# EasyEDA Pro project 无线发射端.eprj

# Schematic Sheet1
Board Name: Board1; Create Date: 2025-03-26; Page Name: Sheet1; Project Name: 无线发射端; Schematic Name: Sheet1; Update Date: 2025-05-02; Address1: *; Address2: *; Address3: *; Address4: *; Application_BuildNumber: *; ApprovedBy: *; Author: *; CheckedBy: *; CompanyName: *; CurrentDate: *; CurrentTime: *; Date: *; DocumentFullPathAndName: *; DocumentName: *; DocumentNumber: *; DrawnBy: *; Engineer: *; ImagePath: *; ModifiedDate: *; Organization: *; ProjectName: *; Revision: *; Rule: *; SheetNumber: 1; SheetTotal: 1; Time: *; Title: *
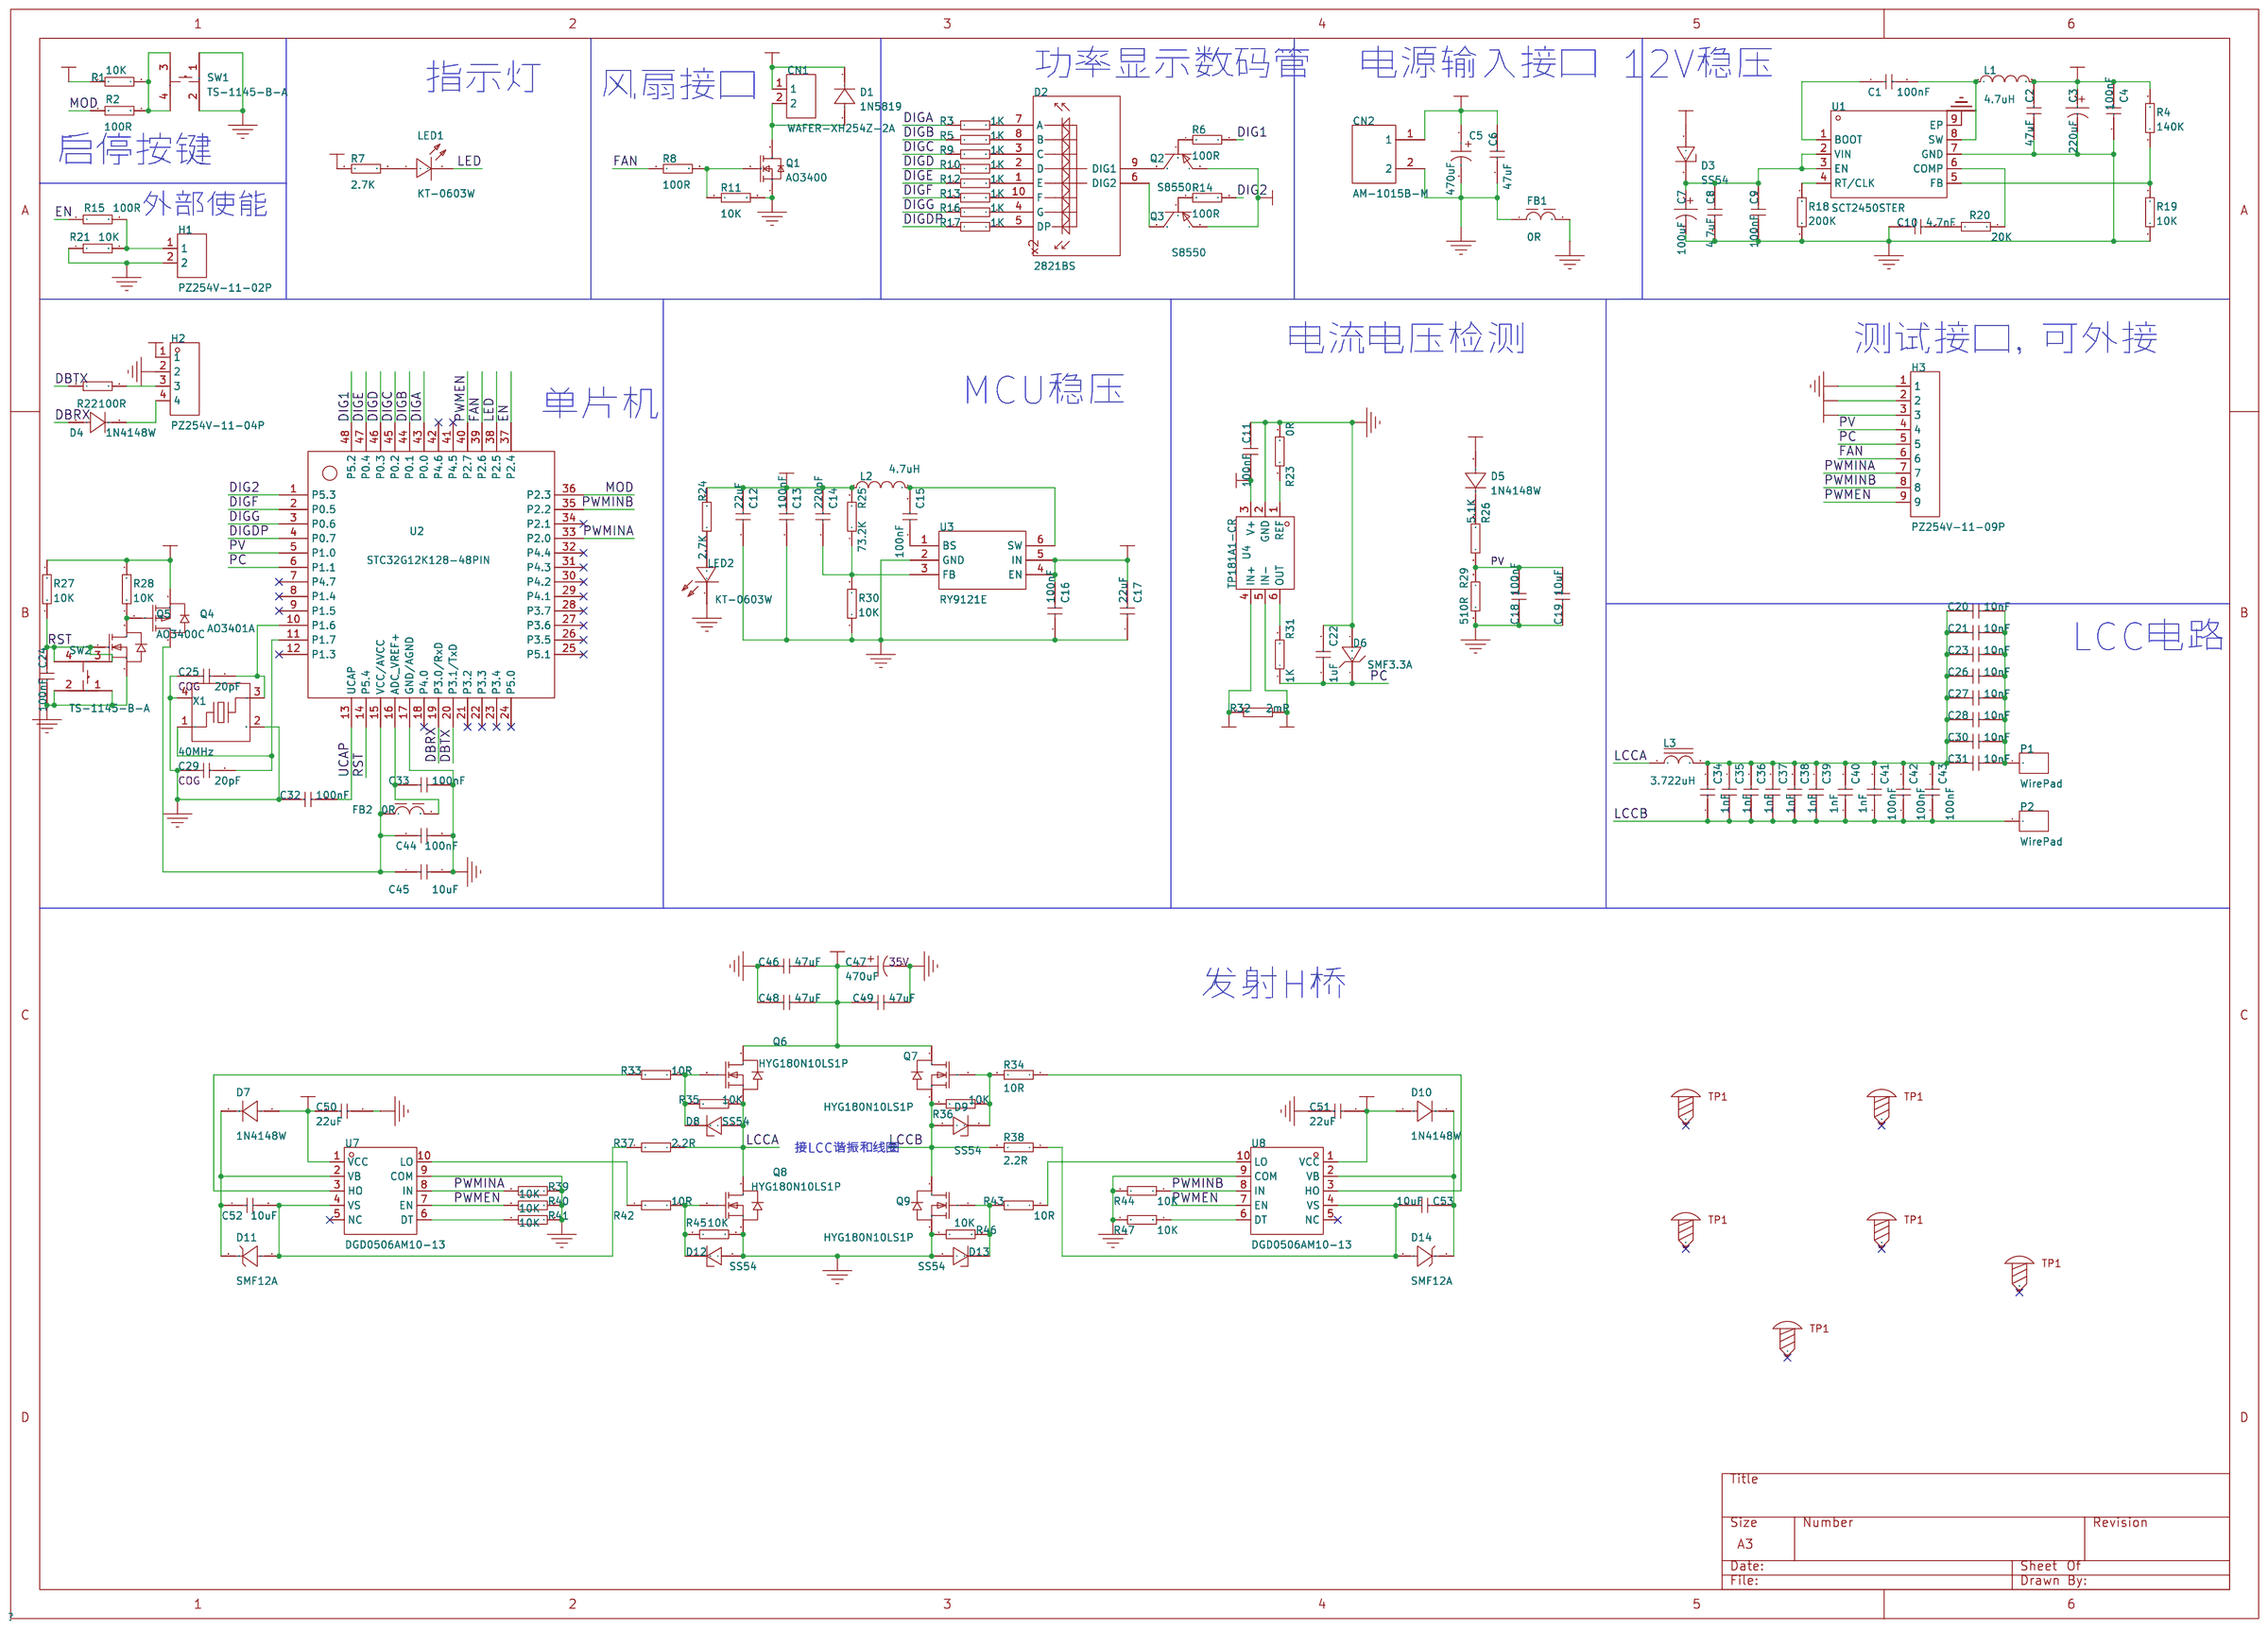
[diagram p0: schematic sheet]

## Parts
C1  100nF  [C0603]
C2  47uF  [C1206]
C3  220uF  [CAP-TH_BD6.3-P2.50-D1.0-FD]
C4  100nF  [C0603]
C5  470uF  [CAP-TH_BD8.0-P3.50-D0.6-FD]
C6  47uF  [C1206]
C7  100uF  [CAP-TH_BD6.3-P2.50-D1.0-FD]
C8  4.7uF  [C0603]
C9  100nF  [C0603]
C10  4.7nF  [C0603]
C11  100nF  [C0603]
C12  22uF  [C0805]
C13  100nF  [C0603]
C14  220pF  [C0603]
C15  100nF  [C0603]
C16  100nF  [C0603]
C17  22uF  [C0805]
C18  100nF  [C0603]
C19  10uF  [C0805]
C20  10nF  [C1206]
C21  10nF  [C1206]
C22  1uF  [C0603]
C23  10nF  [C1206]
C24  100nF  [C0603]
C25  20pF  [C0603]
C26  10nF  [C1206]
C27  10nF  [C1206]
C28  10nF  [C1206]
C29  20pF  [C0603]
C30  10nF  [C1206]
C31  10nF  [C1206]
C32  100nF  [C0603]
C33  100nF  [C0603]
C34  1nF  [C1206]
C35  1nF  [C1206]
C36  1nF  [C1206]
C37  1nF  [C1206]
C38  1nF  [C1206]
C39  1nF  [C1206]
C40  1nF  [C1206]
C41  100nF  [C1812]
C42  100nF  [C1812]
C43  100nF  [C1812]
C44  100nF  [C0603]
C45  10uF  [C0805]
C46  47uF  [C1206]
C47  470uF  [CAP-TH_BD8.0-P3.50-D0.6-FD]
C48  47uF  [C1206]
C49  47uF  [C1206]
C50  22uF  [C0805]
C51  22uF  [C0805]
C52  10uF  [C0805]
C53  10uF  [C0805]
CN1  WAFER-XH254Z-2A  [CONN-TH_2P-P2.50_XH-2A_3045048]
CN2  AM-1015B-M  [CONN-TH_AM-1015B-M]
D1  1N5819  [SMA_L4.3-W2.6-LS5.1-RD]
D2  2821BS  [LED-SEG-TH_10P-L15.0-W10.0-P2.54-S7.62-BL]
D3  SS54  [SMA_L4.3-W2.6-LS5.0-FD]
D4  1N4148W  [SOD-123_L2.8-W1.8-LS3.7-RD-1]
D5  1N4148W  [SOD-123_L2.8-W1.8-LS3.7-RD-1]
D6  SMF3.3A  [SOD-123_L2.8-W1.8-LS3.7-RD]
D7  1N4148W  [SOD-123_L2.8-W1.8-LS3.7-RD-1]
D8  SS54  [SMA_L4.3-W2.6-LS5.0-FD]
D9  SS54  [SMA_L4.3-W2.6-LS5.0-FD]
D10  1N4148W  [SOD-123_L2.8-W1.8-LS3.7-RD-1]
D11  SMF12A  [SOD-123FL_L2.8-W1.8-LS3.8-R-RD]
D12  SS54  [SMA_L4.3-W2.6-LS5.0-FD]
D13  SS54  [SMA_L4.3-W2.6-LS5.0-FD]
D14  SMF12A  [SOD-123FL_L2.8-W1.8-LS3.8-R-RD]
FB1  0R  [R0603]
FB2  0R  [R0603]
H1  PZ254V-11-02P  [HDR-TH_2P-P2.54-V-M]
H2  PZ254V-11-04P  [HDR-TH_4P-P2.54-V-M]
H3  PZ254V-11-09P  [HDR-TH_9P-P2.54-V-M]
L1  4.7uH  [IND-SMD_L7.0-W6.6]
L2  4.7uH  [IND-SMD_L7.0-W6.6]
L3  3.722uH  [T106-LAY]
LED1  KT-0603W  [LED0603-R-RD_WHITE]
LED2  KT-0603W  [LED0603-R-RD_WHITE]
P1  WirePad  [WIREPAD-4X6]
P2  WirePad  [WIREPAD-4X6]
Q1  AO3400  [AO3400A_SOT-23-3]
Q2  S8550  [SOT-23-3_L2.9-W1.3-P1.90-LS2.4-BR]
Q3  S8550  [SOT-23-3_L2.9-W1.3-P1.90-LS2.4-BR]
Q4  AO3401A  [SOT-23_L2.9-W1.3-P1.90-LS2.4-BR]
Q5  AO3400C  [SOT-23-3_L2.9-W1.3-P1.90-LS2.4-BR]
Q6  HYG180N10LS1P  [TO-220-3_L9.9-W4.5-P2.54-L]
Q7  HYG180N10LS1P  [TO-220-3_L9.9-W4.5-P2.54-L]
Q8  HYG180N10LS1P  [TO-220-3_L9.9-W4.5-P2.54-L]
Q9  HYG180N10LS1P  [TO-220-3_L9.9-W4.5-P2.54-L]
R1  10K  [R0603]
R2  100R  [R0603]
R3  1K  [R0603]
R4  140K  [R0603]
R5  1K  [R0603]
R6  100R  [R0603]
R7  2.7K  [R0603]
R8  100R  [R0603]
R9  1K  [R0603]
R10  1K  [R0603]
R11  10K  [R0603]
R12  1K  [R0603]
R13  1K  [R0603]
R14  100R  [R0603]
R15  100R  [R0603]
R16  1K  [R0603]
R17  1K  [R0603]
R18  200K  [R0603]
R19  10K  [R0603]
R20  20K  [R0603]
R21  10K  [R0603]
R22  100R  [R0603]
R23  0R  [R0603]
R24  2.7K  [R0603]
R25  73.2K  [R0603]
R26  5.1K  [R0603]
R27  10K  [R0603]
R28  10K  [R0603]
R29  510R  [R0603]
R30  10K  [R0603]
R31  1K  [R0603]
R32  2mR  [R2512]
R33  10R  [R0603]
R34  10R  [R0603]
R35  10K  [R0603]
R36  10K  [R0603]
R37  2.2R  [R0603]
R38  2.2R  [R0603]
R39  10K  [R0603]
R40  10K  [R0603]
R41  10K  [R0603]
R42  10R  [R0603]
R43  10R  [R0603]
R44  10K  [R0603]
R45  10K  [R0603]
R46  10K  [R0603]
R47  10K  [R0603]
SW1  TS-1145-B-A  [SW-SMD_4P-L4.2-W3.2-P2.15-LS4.6-2]
SW2  TS-1145-B-A  [SW-SMD_4P-L4.2-W3.2-P2.15-LS4.6-2]
U1  SCT2450STER  [ESOP-8_L4.9-W3.9-P1.27-LS6.0-BL-EP]
U2  STC32G12K128-48PIN  [LQFP48_L]
U3  RY9121E  [SOT-23-6]
U4  TP181A1-CR  [SC70-6_L2.1-W1.3-P0.65-LS2.3-BL]
U5  -  [M3]
U6  -  [M3]
U7  DGD0506AM10-13  [MSOP-10_L3.0-W3.0-P0.50-LS5.0-BL]
U8  DGD0506AM10-13  [MSOP-10_L3.0-W3.0-P0.50-LS5.0-BL]
U9  -  [M3]
U10  -  [M3]
U11  -  [M3]
U12  -  [M3]
X1  40MHz  [CRYSTAL-SMD_4P-L3.2-W2.5-BL]

## Library data of the parts
C1 C4 C9 C11 C13 C15 C16 C18 C24 C32 C33 C44 = =Value +' '+ Voltage + ' ' + Type: 贴片瓷片电容; MLCC; 0603(1608);; Revision: V1.0; Voltage: 50V; Type: X7R; Origin Footprint 2: CAPC1608[0603]-L; Origin Footprint 3: CAPC1608[0603]-M; Origin Footprint 4: CAPC1608[0603]-N; Origin Footprint 5: CAPC1608[0603]S-L; Origin Footprint 6: CAPC1608[0603]S-M; Origin Footprint 1: CAPC1608[0603]S-N; Design Item ID: 100nF 0603 50V X7R; Library Name: WirelessChargingHost_HBridge
C2 = =Value +' '+ Voltage + ' ' + Type: 贴片瓷片电容; MLCC; 1206(3216);; Revision: V1.0; Voltage: 25V; Type: X5R; Origin Footprint 2: CAPC3216[1206]; Origin Footprint 1: CAPC3216[1206]S; Design Item ID: 47uF 1206 25V X5R; Library Name: WirelessChargingHost_HBridge
C3 C7 = SPZ1VM101E08O00RAXXX: LCSC Part Name: 100uF ±20% 35V; Supplier Part: C122240; Manufacturer: AISHI(艾华集团); Supplier Footprint: 插件,D6.3xL8mm; JLCPCB Part Class: 扩展库; Datasheet: https://atta.szlcsc.com/upload/public/pdf/source/20170721/C122240_1500619276730834029.pdf; Supplier: LCSC; Tolerance: ±20%; Voltage Rating: 35V; Ripple Current: 2.35A@100kHz; Equivalent Series Resistance(ESR): 50mΩ@100kHz; Pin Spacing: 2.5mm; Diameter: 6.3mm; Height - Seated (Max): 8mm; Lifetime: 2000hrs@105℃; Operating Temperature: -55℃~+105℃
C5 = KNH2470UF35V149EC029: LCSC Part Name: 470uF 35V; Supplier Part: C5155349; Manufacturer: KNSCHA(科尼盛); Supplier Footprint: 插件,D8xL14mm; JLCPCB Part Class: 扩展库; Datasheet: https://atta.szlcsc.com/upload/public/pdf/source/20220901/A0D6BA87A5215908601C61D24FEF08D2.pdf; Supplier: LCSC; Rated Voltage: 35V
C6 C46 C48 C49 = =Value +' '+ Voltage + ' ' + Type: 贴片瓷片电容; MLCC; 1812(4532);; Revision: V1.0; Voltage: 50V; Type: X5R; Origin Footprint 2: CAPC4532[1812]; Origin Footprint 1: CAPC4532[1812]S; Design Item ID: 47uF 1812 50V X5R; Library Name: WirelessChargingHost_HBridge
C8 = =Value +' '+ Voltage + ' ' + Type: 贴片瓷片电容; MLCC; 1206(3216);; Revision: V1.0; Voltage: 35V; Type: X5R; Origin Footprint 2: CAPC3216[1206]; Origin Footprint 1: CAPC3216[1206]S; Design Item ID: 4.7uF 1206 35V X5R; Library Name: WirelessChargingHost_HBridge
C10 = =Value +' '+ Voltage + ' ' + Type: 贴片瓷片电容; MLCC; 0603(1608);; Revision: V1.0; Voltage: 50V; Type: X7R; Origin Footprint 2: CAPC1608[0603]-L; Origin Footprint 3: CAPC1608[0603]-M; Origin Footprint 4: CAPC1608[0603]-N; Origin Footprint 5: CAPC1608[0603]S-L; Origin Footprint 6: CAPC1608[0603]S-M; Origin Footprint 1: CAPC1608[0603]S-N; Design Item ID: 4.7nF 0603 50V X7R; Library Name: WirelessChargingHost_HBridge
C12 C17 C50 C51 = =Value +' '+ Voltage + ' ' + Type: 贴片瓷片电容; MLCC; 0805(2012);; Revision: V1.0; Voltage: 25V; Type: X5R; Origin Footprint 2: CAPC2012[0805]; Origin Footprint 3: CAPC2012[0805]S-L; Origin Footprint 4: CAPC2012[0805]S-M; Origin Footprint 1: CAPC2012[0805]S-N; Design Item ID: 22uF 0805 25V X5R; Library Name: WirelessChargingHost_HBridge
C14 = =Value +' '+ Voltage + ' ' + Type: 贴片瓷片电容; MLCC; 0603(1608);; Revision: V1.0; Voltage: 50V; Type: X7R; Origin Footprint 2: CAPC1608[0603]-L; Origin Footprint 3: CAPC1608[0603]-M; Origin Footprint 4: CAPC1608[0603]-N; Origin Footprint 5: CAPC1608[0603]S-L; Origin Footprint 6: CAPC1608[0603]S-M; Origin Footprint 1: CAPC1608[0603]S-N; Design Item ID: 220pF 0603 50V X7R; Library Name: WirelessChargingHost_HBridge
C19 C45 C52 C53 = =Value +' '+ Voltage + ' ' + Type: 贴片瓷片电容; MLCC; 0805(2012);; Revision: V1.0; Voltage: 25V; Type: X5R; Origin Footprint 2: CAPC2012[0805]; Origin Footprint 3: CAPC2012[0805]S-L; Origin Footprint 4: CAPC2012[0805]S-M; Origin Footprint 1: CAPC2012[0805]S-N; Design Item ID: 10uF 0805 25V X5R; Library Name: WirelessChargingHost_HBridge
C20 C21 C23 C26-C28 C30 C31 = =Value +' '+ Voltage + ' ' + Type: 贴片瓷片电容; MLCC; 1206(3216);; Revision: V1.0; Voltage: 100V; Type: C0G; Origin Footprint 2: CAPC3216[1206]; Origin Footprint 1: CAPC3216[1206]S; Design Item ID: 10nF 1206 100V C0G; Library Name: WirelessChargingHost_HBridge
C22 = =Value +' '+ Voltage + ' ' + Type: 贴片瓷片电容; MLCC; 0603(1608);; Revision: V1.0; Voltage: 16V; Type: X7R; Origin Footprint 2: CAPC1608[0603]-L; Origin Footprint 3: CAPC1608[0603]-M; Origin Footprint 4: CAPC1608[0603]-N; Origin Footprint 5: CAPC1608[0603]S-L; Origin Footprint 6: CAPC1608[0603]S-M; Origin Footprint 1: CAPC1608[0603]S-N; Design Item ID: 1uF 0603 16V X7R; Library Name: WirelessChargingHost_HBridge
C25 C29 = =Value +' '+ Voltage + ' ' + Type: 贴片瓷片电容; MLCC; 0603(1608);; Revision: V1.0; Voltage: 50V; Type: COG; Origin Footprint 2: CAPC1608[0603]-L; Origin Footprint 3: CAPC1608[0603]-M; Origin Footprint 4: CAPC1608[0603]-N; Origin Footprint 5: CAPC1608[0603]S-L; Origin Footprint 6: CAPC1608[0603]S-M; Origin Footprint 1: CAPC1608[0603]S-N; Design Item ID: 20pF 0603 50V C0G; Library Name: WirelessChargingHost_HBridge
C34-C40 = =Value +' '+ Voltage + ' ' + Type: 贴片瓷片电容; MLCC; 1206(3216);; Revision: V1.0; Voltage: 100V; Type: C0G; Origin Footprint 2: CAPC3216[1206]; Origin Footprint 1: CAPC3216[1206]S; Design Item ID: 1nF 1206 100V C0G; Library Name: WirelessChargingHost_HBridge
C41-C43 = =Value +' '+ Voltage + ' ' + Type: 贴片瓷片电容; MLCC; 1206(3216);; Revision: V1.0; Voltage: 100V; Type: C0G; Origin Footprint 2: CAPC3216[1206]; Origin Footprint 1: CAPC3216[1206]S; Design Item ID: 100nF 1206 100V C0G; Library Name: WirelessChargingHost_HBridge
C47 = KNH2470UF35V149EC029: LCSC Part Name: 35V; Supplier Part: C5155349; Manufacturer: KNSCHA(科尼盛); Supplier Footprint: 插件,D8xL14mm; JLCPCB Part Class: 扩展库; Datasheet: https://atta.szlcsc.com/upload/public/pdf/source/20220901/A0D6BA87A5215908601C61D24FEF08D2.pdf; Supplier: LCSC; Rated Voltage: 35V
CN1 = WAFER-XH254Z-2A: Supplier Part: C7432682; Manufacturer: HANBO(汉博); Supplier Footprint: 插件,P=2.5mm; JLCPCB Part Class: 扩展库; Datasheet: https://atta.szlcsc.com/upload/public/pdf/source/20230718/3B4FABA5D38EFB02DAF74E7C2B33D98F.pdf; Supplier: LCSC; Pins Structure: 1x2P; Pitch: 2.54mm; Mounting Style: 直插; Reference Series: XH; Number of Pins: 2P; Number of Rows: 1; Number of PINs Per Row: 2; Current Rating (Max): 3A; Operating Temperature Range: -25℃~+85℃
CN2 = AM-1015B-M: LCSC Part Name: AMASS(艾迈斯)电源连接器公头AM-1015B-M; Supplier Part: C90631; Manufacturer: AMASS(艾迈斯); JLCPCB Part Class: 扩展库; Datasheet: https://atta.szlcsc.com/upload/public/pdf/source/20161217/1481939174683.pdf; Supplier: LCSC; Brand: 艾迈斯; Type: T行插头; RatedVoltage: DC 500V; InterfaceType: 双公头; MetalMaterial: 铜镀金; InsulationMaterial: PA; RatedCurrent: 25A; RecommendedWireGauge: 12AWG; FlameRetardantGrade: UL94 V0; contact resistance: 0.45mΩ
D1 = 1N5819: Supplier Part: C9900008009; JLCPCB Part Class: 扩展库; Supplier: LCSC
D2 = 2821BS: 0.28寸 2位数码管 共阳; Library Name: WirelessChargingHost_HBridge
D3 D8 D9 D12 D13 = SS54_C7420369: LCSC Part Name: 电压:40V 电流:5A; Supplier Part: C7420369; Manufacturer: 宏迦橙; Supplier Footprint: SMA(DO-214AC); JLCPCB Part Class: 扩展库; Datasheet: https://atta.szlcsc.com/upload/public/pdf/source/20230828/254C3882F8647358AD9F60DD73611B5E.pdf; Supplier: LCSC; Diode Configuration: 独立式; Forward Voltage (Vf@If): 550mV@5.0A; Reverse Voltage (Vr): 40V; Rectified Current: 5A; Reverse Leakage Current (Ir): 50uA@40V
D4 D5 D7 D10 = 1N4148W_C917030: Supplier Part: C917030; Manufacturer: JSMSEMI(杰盛微); Supplier Footprint: SOD-123; JLCPCB Part Class: 扩展库; Datasheet: https://atta.szlcsc.com/upload/public/pdf/source/20230807/C928F35F082AC22834996B2570733516.pdf; Supplier: LCSC; Diode Configuration: 独立式; Forward Voltage (Vf@If): 1.25V@150mA; Reverse Voltage (Vr): 100V; Rectified Current: 300mA; Reverse Leakage Current (Ir): 1uA@75V; Reverse Recovery Time (trr): 8ns; Operating Temperature: -55℃~+150℃@(Tj)
D6 = SMF3.3A_C283866: Supplier Part: C283866; Manufacturer: DOWO(东沃); Supplier Footprint: SOD-123FL; JLCPCB Part Class: 扩展库; Datasheet: https://atta.szlcsc.com/upload/public/pdf/source/20240321/1BA336232F2D97E4B026619682DB80D3.pdf; Supplier: LCSC; Reverse Stand-Off Voltage (Vrwm): 3.3V; Maximum Clamping Voltage: 8V; Peak Pulse Current (Ipp)@10/1000us: 25A; Breakdown Voltage: 5.2V; Reverse Leakage Current (Ir): 600uA; Type: TVS
D11 D14 = SMF12A_C19077506: Supplier Part: C19077506; Manufacturer: 宏迦橙; Supplier Footprint: SOD-123FL; JLCPCB Part Class: 扩展库; Datasheet: https://atta.szlcsc.com/upload/public/pdf/source/20231129/4813F17DC56F8B344A8D004597B3633C.pdf; Supplier: LCSC; polarity: 单向; Reverse Stand-Off Voltage (Vrwm): 12V; Maximum Clamping Voltage: 19.9V; Peak Pulse Current (Ipp)@10/1000us: 10.1A; Peak Pulse Power Dissipation (Ppp)@10/1000us: 200W; Breakdown Voltage: 14.7V; Reverse Leakage Current (Ir): 2.5uA; Operating Temperature: -55℃~+155℃; Type: TVS
FB1 FB2 = =Value + ' ' + Frequency +' '+ Imax: 贴片磁珠; Published: 2020-12-18; Revision: V1.0; DCR: .1m; Frequency: @100MHz; Imax: 500mA; Origin Footprint 2: INDC2012[0805]S; Origin Footprint 3: INDC3216[1206]S; Origin Footprint 4: INDC4509[1806]S; Origin Footprint 5: INDC1005[0402]; Origin Footprint 6: INDC1608[0603]; Origin Footprint 7: INDC2012[0805]; Origin Footprint 8: INDC3216[1206]; Origin Footprint 9: INDC3225[1210]; Origin Footprint 10: INDC3216[1206]; Origin Footprint 11: INDC1005[0402]S; Origin Footprint 1: INDC1608[0603]S; Design Item ID: FB-Chip; Library Name: WirelessChargingHost_HBridge
H1 = PZ254V-11-02P: LCSC Part Name: 1x2P 间距:2.54mm 方针 直插; Supplier Part: C492401; Manufacturer: XFCN(兴飞); Supplier Footprint: 插件,P=2.54mm; JLCPCB Part Class: 扩展库; Datasheet: https://atta.szlcsc.com/upload/public/pdf/source/20200309/C492401_A812433581A9B211A7FFA413ADDFF0E5.pdf; Supplier: LCSC; Pin Structure: 1x2P; Pitch: 2.54mm; Circluar Pins/Square Pins: 方针; Mounting Type: 直插; Number of Rows: 单排; Number of Pins: 2P; Length of Mating Pin: 6mm; Insulation Height: 2.5mm; Length of End Connection Pin: 3mm; Contact Material: 黄铜; Operating Temperature: -40℃~+105℃; Color: 黑色
H2 = PZ254V-11-04P: LCSC Part Name: 间距:2.54mm 1x4P 直插 方针; Supplier Part: C2691448; Manufacturer: XFCN(兴飞); Supplier Footprint: 插件,P=2.54mm; JLCPCB Part Class: 扩展库; Datasheet: https://atta.szlcsc.com/upload/public/pdf/source/20200309/C492403_F9F19131791D08044AD4F84F8E751A34.pdf; Supplier: LCSC; Pin Structure: 1x4P; Pitch: 2.54mm; Circluar Pins/Square Pins: 方针; Mounting Type: 直插; Number of Rows: 单排; Number of Pins: 4P; Current Rating (Max): 3A; Voltage Rating (Max): 250V; Length of Mating Pin: 6mm; Insulation Height: 2.5mm; Length of End Connection Pin: 3mm; Operating Temperature Range: -40℃~+105℃; Color: 黑色
H3 = PZ254V-11-09P: LCSC Part Name: 1x9P 间距:2.54mm 方针 直插; Supplier Part: C492408; Manufacturer: XFCN(兴飞); Supplier Footprint: 插件,P=2.54mm; JLCPCB Part Class: 扩展库; Datasheet: https://atta.szlcsc.com/upload/public/pdf/source/20200309/C492408_0CE6AEE885DD471CEFA4BE32B6482CF7.pdf; Supplier: LCSC; Pin Structure: 1x9P; Pitch: 2.54mm; Circluar Pins/Square Pins: 方针; Mounting Type: 直插; Number of Rows: 单排; Number of Pins: 9P; Length of Mating Pin: 6mm; Insulation Height: 2.5mm; Length of End Connection Pin: 3mm; Contact Material: 黄铜; Operating Temperature: -40℃~+105℃; Color: 黑色
L1 L2 = FXL0630-4R7-M: LCSC Part Name: 4.7uH ±20% 9A; Supplier Part: C167220; Manufacturer: cjiang(长江微电); Supplier Footprint: SMD,6.6x7mm; JLCPCB Part Class: 扩展库; Datasheet: https://atta.szlcsc.com/upload/public/pdf/source/20240426/3189EA8206330E2108542F9E34E540E7.pdf; Supplier: LCSC; Tolerance: ±20%; Rated Current: 6A; Saturation Current (Isat): 9A; DC Resistance (DCR): 33mΩ; Type: 一体成型电感
L3 = 3.722uH: 功率电感; Published: 8-Jun-2000; Revision: July-2002: Re-released for DXP Platform.; Publisher: Altium Limited; Imax: 50mA; DCR: .5m; Price(RMB): 0.000; Origin Footprint 2: CD31; Origin Footprint 3: CD32; Origin Footprint 4: CD42; Origin Footprint 5: CD43; Origin Footprint 6: CD52; Origin Footprint 7: CD53; Origin Footprint 8: CD54; Origin Footprint 9: CD73; Origin Footprint 10: CD75; Origin Footprint 11: CD104; Origin Footprint 12: CD105; Origin Footprint 13: CD106; Origin Footprint 14: 127 Shielded 12.5*12.5*7; Origin Footprint 15: 0630 TPC 7*7*3; Origin Footprint 16: 1050 TPC 10*10*5; Origin Footprint 17: 1265 TPC 12*12*6.5; Origin Footprint 18: CD104R; Origin Footprint 19: SLO2520; Origin Footprint 20: 1365 TPC 13*13*6.5; Origin Footprint 21: T80125; Design Item ID: Ind-Power_1; Library Name: WirelessChargingHost_HBridge
LED1 LED2 = KT-0603W: LCSC Part Name: 0603 白灯 高亮; Supplier Part: C2290; Manufacturer: KENTO; Supplier Footprint: 0603; JLCPCB Part Class: 基础库; Datasheet: https://atta.szlcsc.com/upload/public/pdf/source/20221101/4C23D5C85BA051E44A00B833D0A41468.pdf; Supplier: LCSC; Emitted Color: 白色
P1 P2 = WirePad: 线缆焊盘; Origin Footprint 2: WirePad-4.5x7; Origin Footprint 1: WirePad-4x6; Library Name: WirelessChargingHost_HBridge
Q1 = AO3400: N-Channel SOT-23 MOSFET; Library Name: WirelessChargingHost_HBridge
Q2 Q3 = S8550_C20069126: LCSC Part Name: hFE:200-350，丝印:2TY S8550; Supplier Part: C20069126; Manufacturer: 宏嘉诚; Supplier Footprint: SOT-23; JLCPCB Part Class: 扩展库; Datasheet: https://atta.szlcsc.com/upload/public/pdf/source/20250107/6DAD7E9AA702AA129A4A0106BAAB5F5A.pdf; Supplier: LCSC; type: PNP; Current - Collector(Ic): 500mA; Collector - Emitter Voltage VCEO: 25V; Pd - Power Dissipation: 300mW; DC Current Gain: 120@500mA,1.0V; Transition frequency(fT): 150MHz; Current - Collector Cutoff: 100nA; Vce Saturation(VCE(sat)): 500mV; Operating Temperature: -55℃~+150℃
Q4 = AO3401A_C15127: LCSC Part Name: 1个P沟道 耐压:30V 电流:4A; Supplier Part: C15127; Manufacturer: AOS; Supplier Footprint: SOT-23; JLCPCB Part Class: 基础库; Datasheet: https://atta.szlcsc.com/upload/public/pdf/source/20160507/1462613609053.pdf; Supplier: LCSC; Type: 1个P沟道; Drain Source Voltage (Vdss): 30V; Continuous Drain Current (Id): 4A; Drain Source On Resistance (RDS(on)@Vgs,Id): 44mΩ@10V,4.3A; Power Dissipation (Pd): 1.4W; Gate Threshold Voltage (Vgs(th)@Id): 1.3V@250uA; Total Gate Charge (Qg@Vgs): 12.2nC@4.5V; Input Capacitance (Ciss@Vds): 1.2nF@15V; Operating Temperature: -55℃~+150℃@(Tj)
Q5 = AO3400C: LCSC Part Name: 1个N沟道 耐压:30V 电流:6.2A; Supplier Part: C541722; Manufacturer: AOS; Supplier Footprint: SOT-23; JLCPCB Part Class: 扩展库; Datasheet: https://atta.szlcsc.com/upload/public/pdf/source/20200908/C541722_AFBFDB26E86D8C1A63F798809401D99A.pdf; Supplier: LCSC; Type: 1个N沟道; Drain to Source Voltage: 30V; Current - Continuous Drain(Id): 6.2A; RDS(on): 20mΩ@4.5V,5.5A; Gate Threshold Voltage (Vgs(th)@Id): 1.3V; Gate Charge(Qg): 12nC@10V; Input Capacitance(Ciss@Vds): 600pF@15V; Reverse Transfer Capacitance (Crss@Vds): 60pF@15V; Operating Temperature: -55℃~+150℃
Q6-Q9 = HYG180N10LS1P: LCSC Part Name: 单N沟道,电流:50A,耐压:100V; Supplier Part: C2841917; Manufacturer: HUAYI(华羿微); Supplier Footprint: TO-220FB-3; JLCPCB Part Class: 扩展库; Datasheet: https://atta.szlcsc.com/upload/public/pdf/source/20210623/C2841917_DCB502454E2D6891984620DC66A45EFF.pdf; Supplier: LCSC; Type: 1个N沟道; Drain Source Voltage (Vdss): 100V; Continuous Drain Current (Id): 50A; Drain Source On Resistance (RDS(on)@Vgs,Id): 16.5mΩ@10V,25A; Power Dissipation (Pd): 93.7W; Gate Threshold Voltage (Vgs(th)@Id): 1.8V@250uA; Total Gate Charge (Qg@Vgs): 24.6nC@10V; Input Capacitance (Ciss@Vds): 1.606nF; Reverse Transfer Capacitance (Crss@Vds): 22.8pF; Operating Temperature: -55℃~+175℃